# EAGLE schematic Resistor_Resistor (EAGLE 8.3.0), part 1 of 43 (continued)
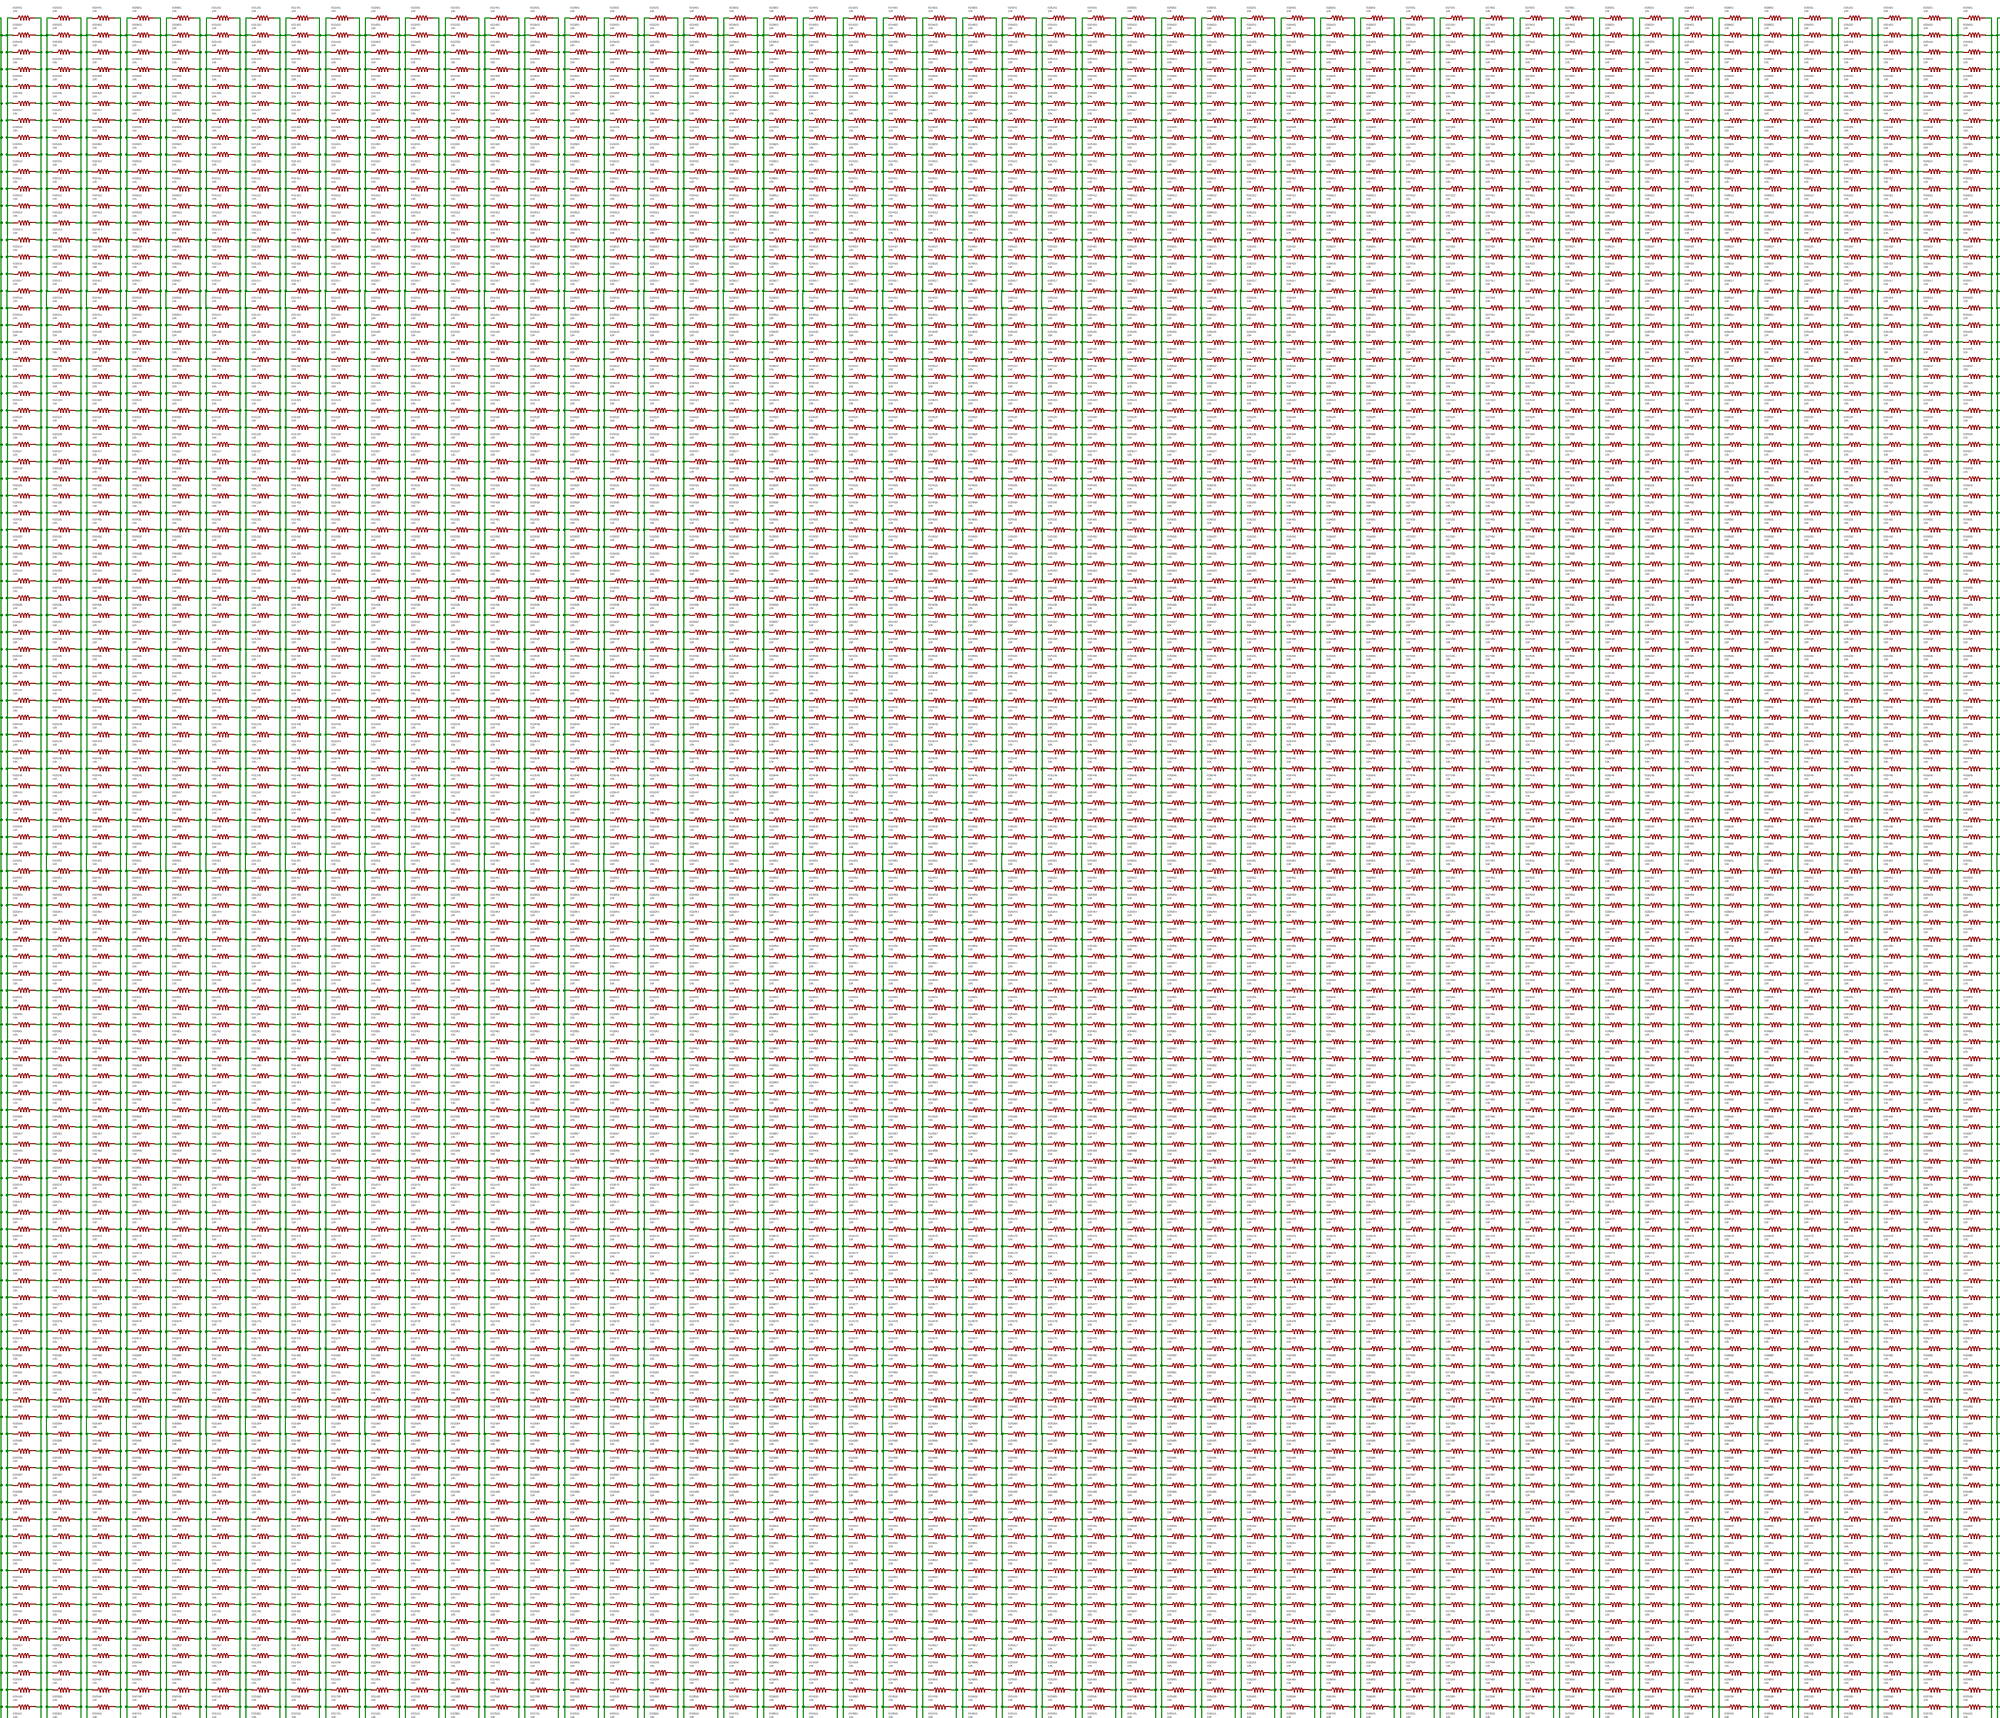
[diagram p5: schematic, sheet 1, part 5 of 8]
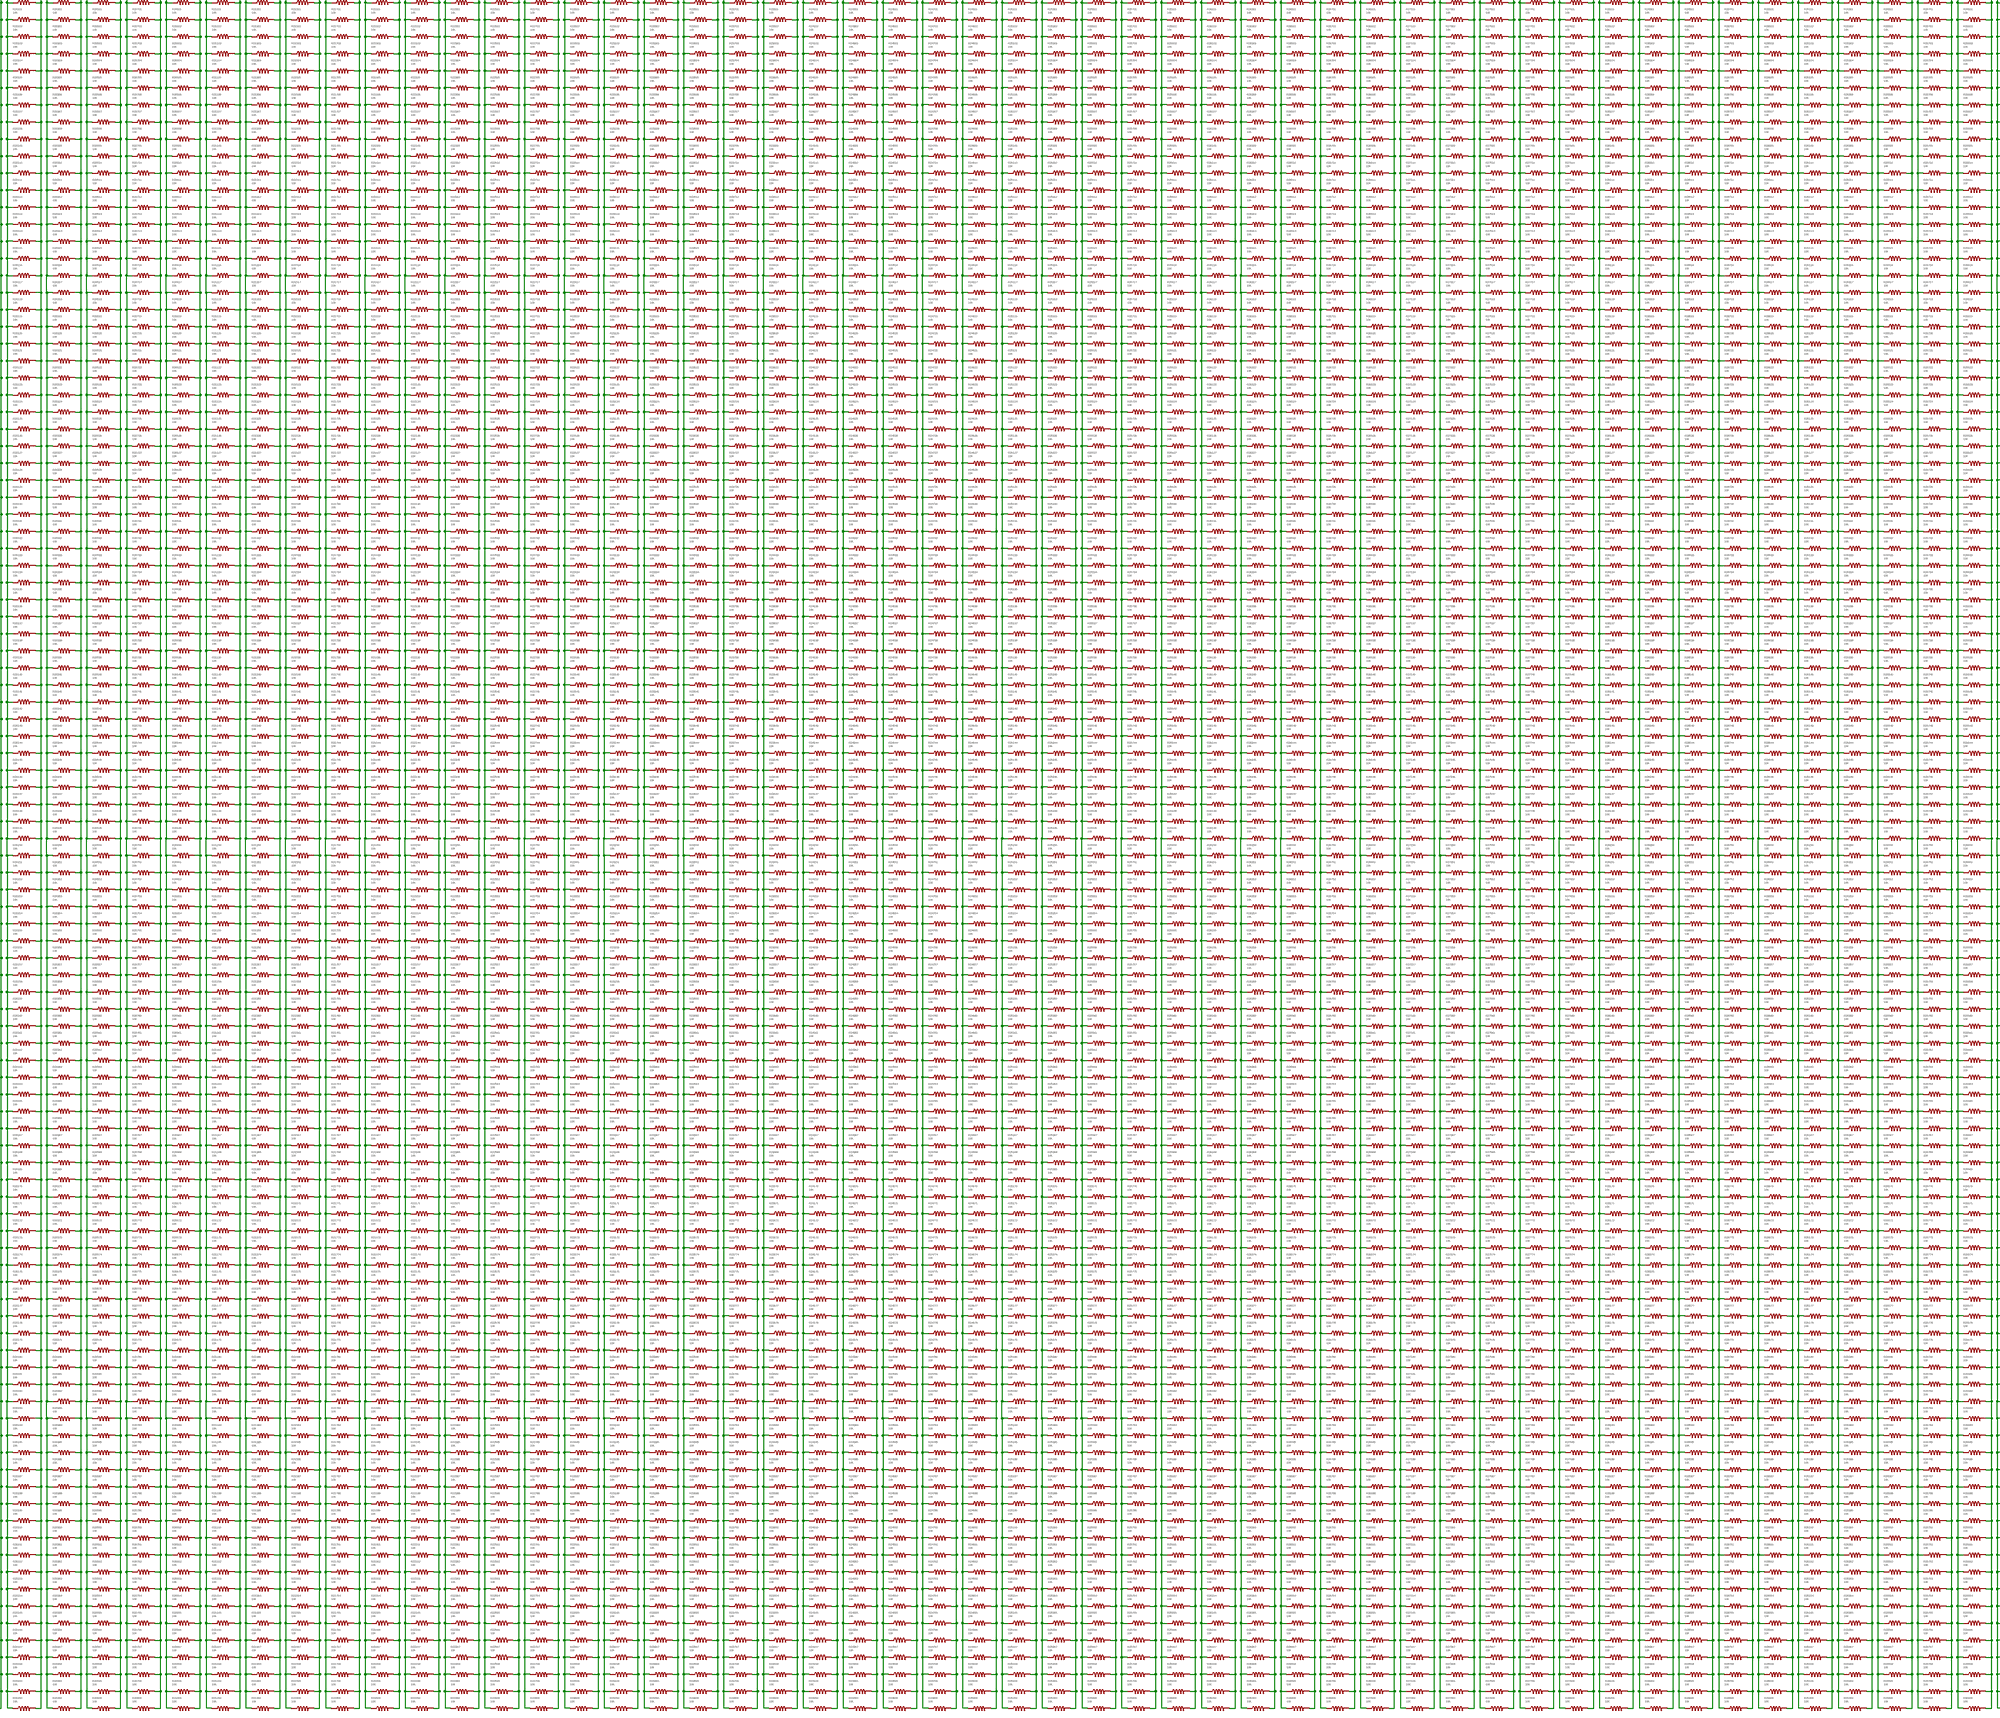
[diagram p6: schematic, sheet 1, part 6 of 8]
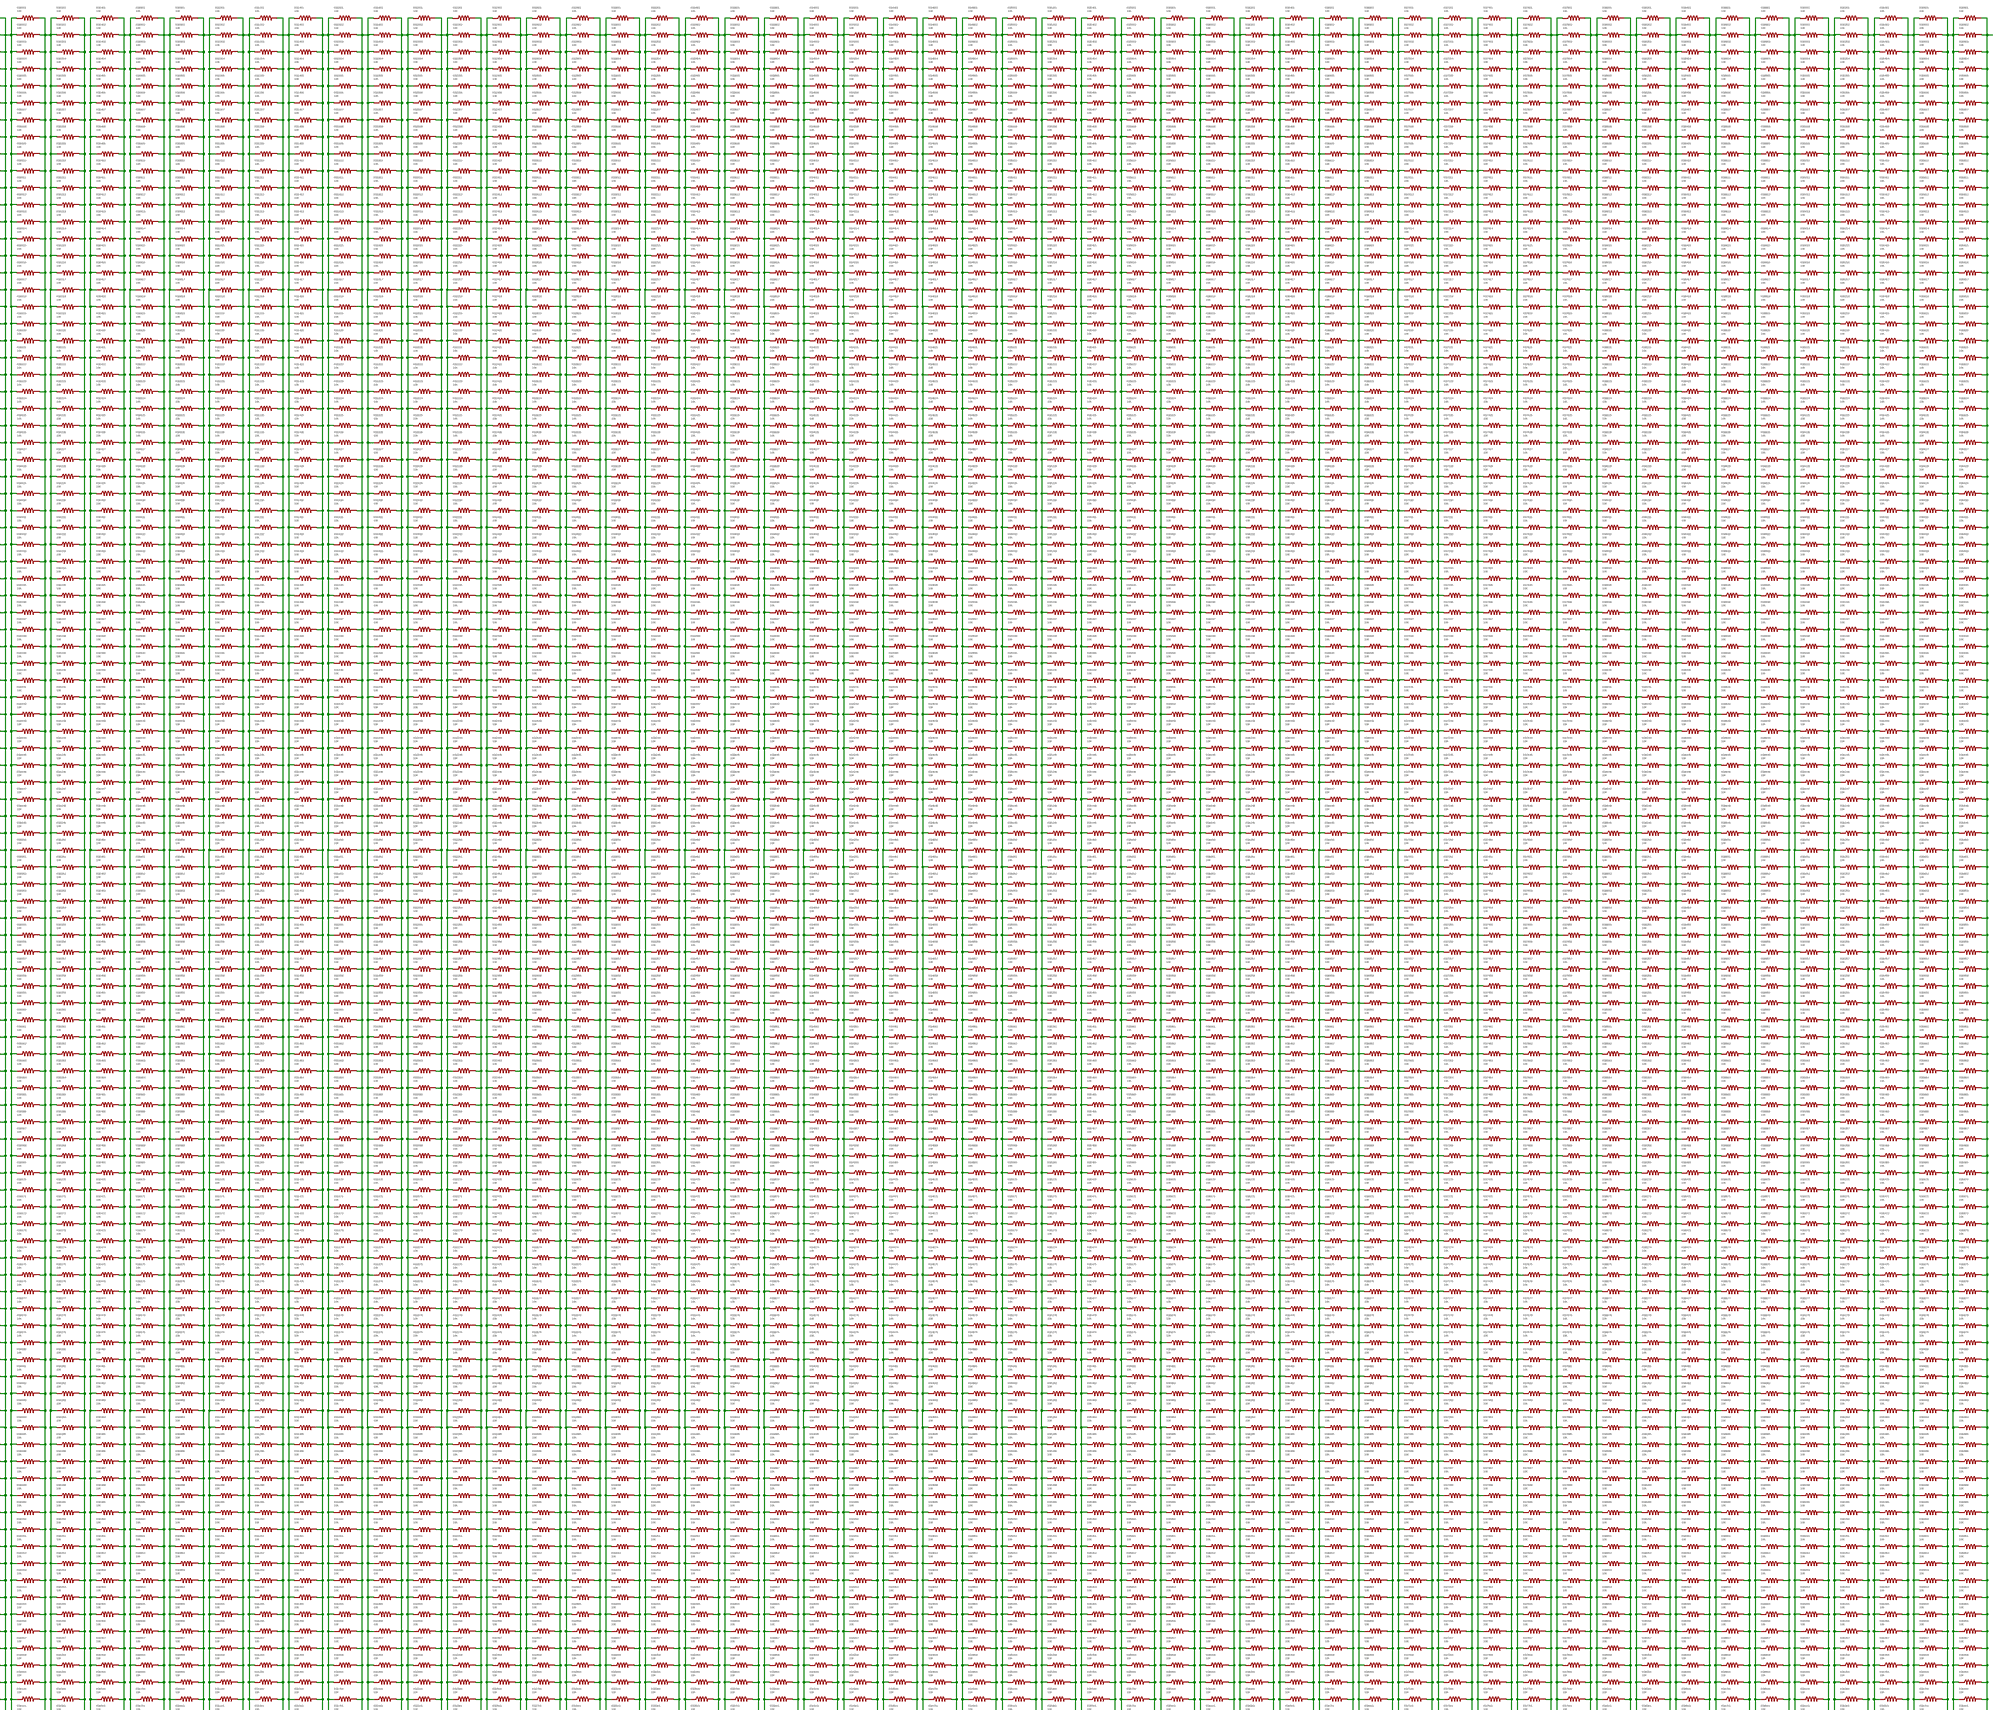
[diagram p7: schematic, sheet 1, part 7 of 8]
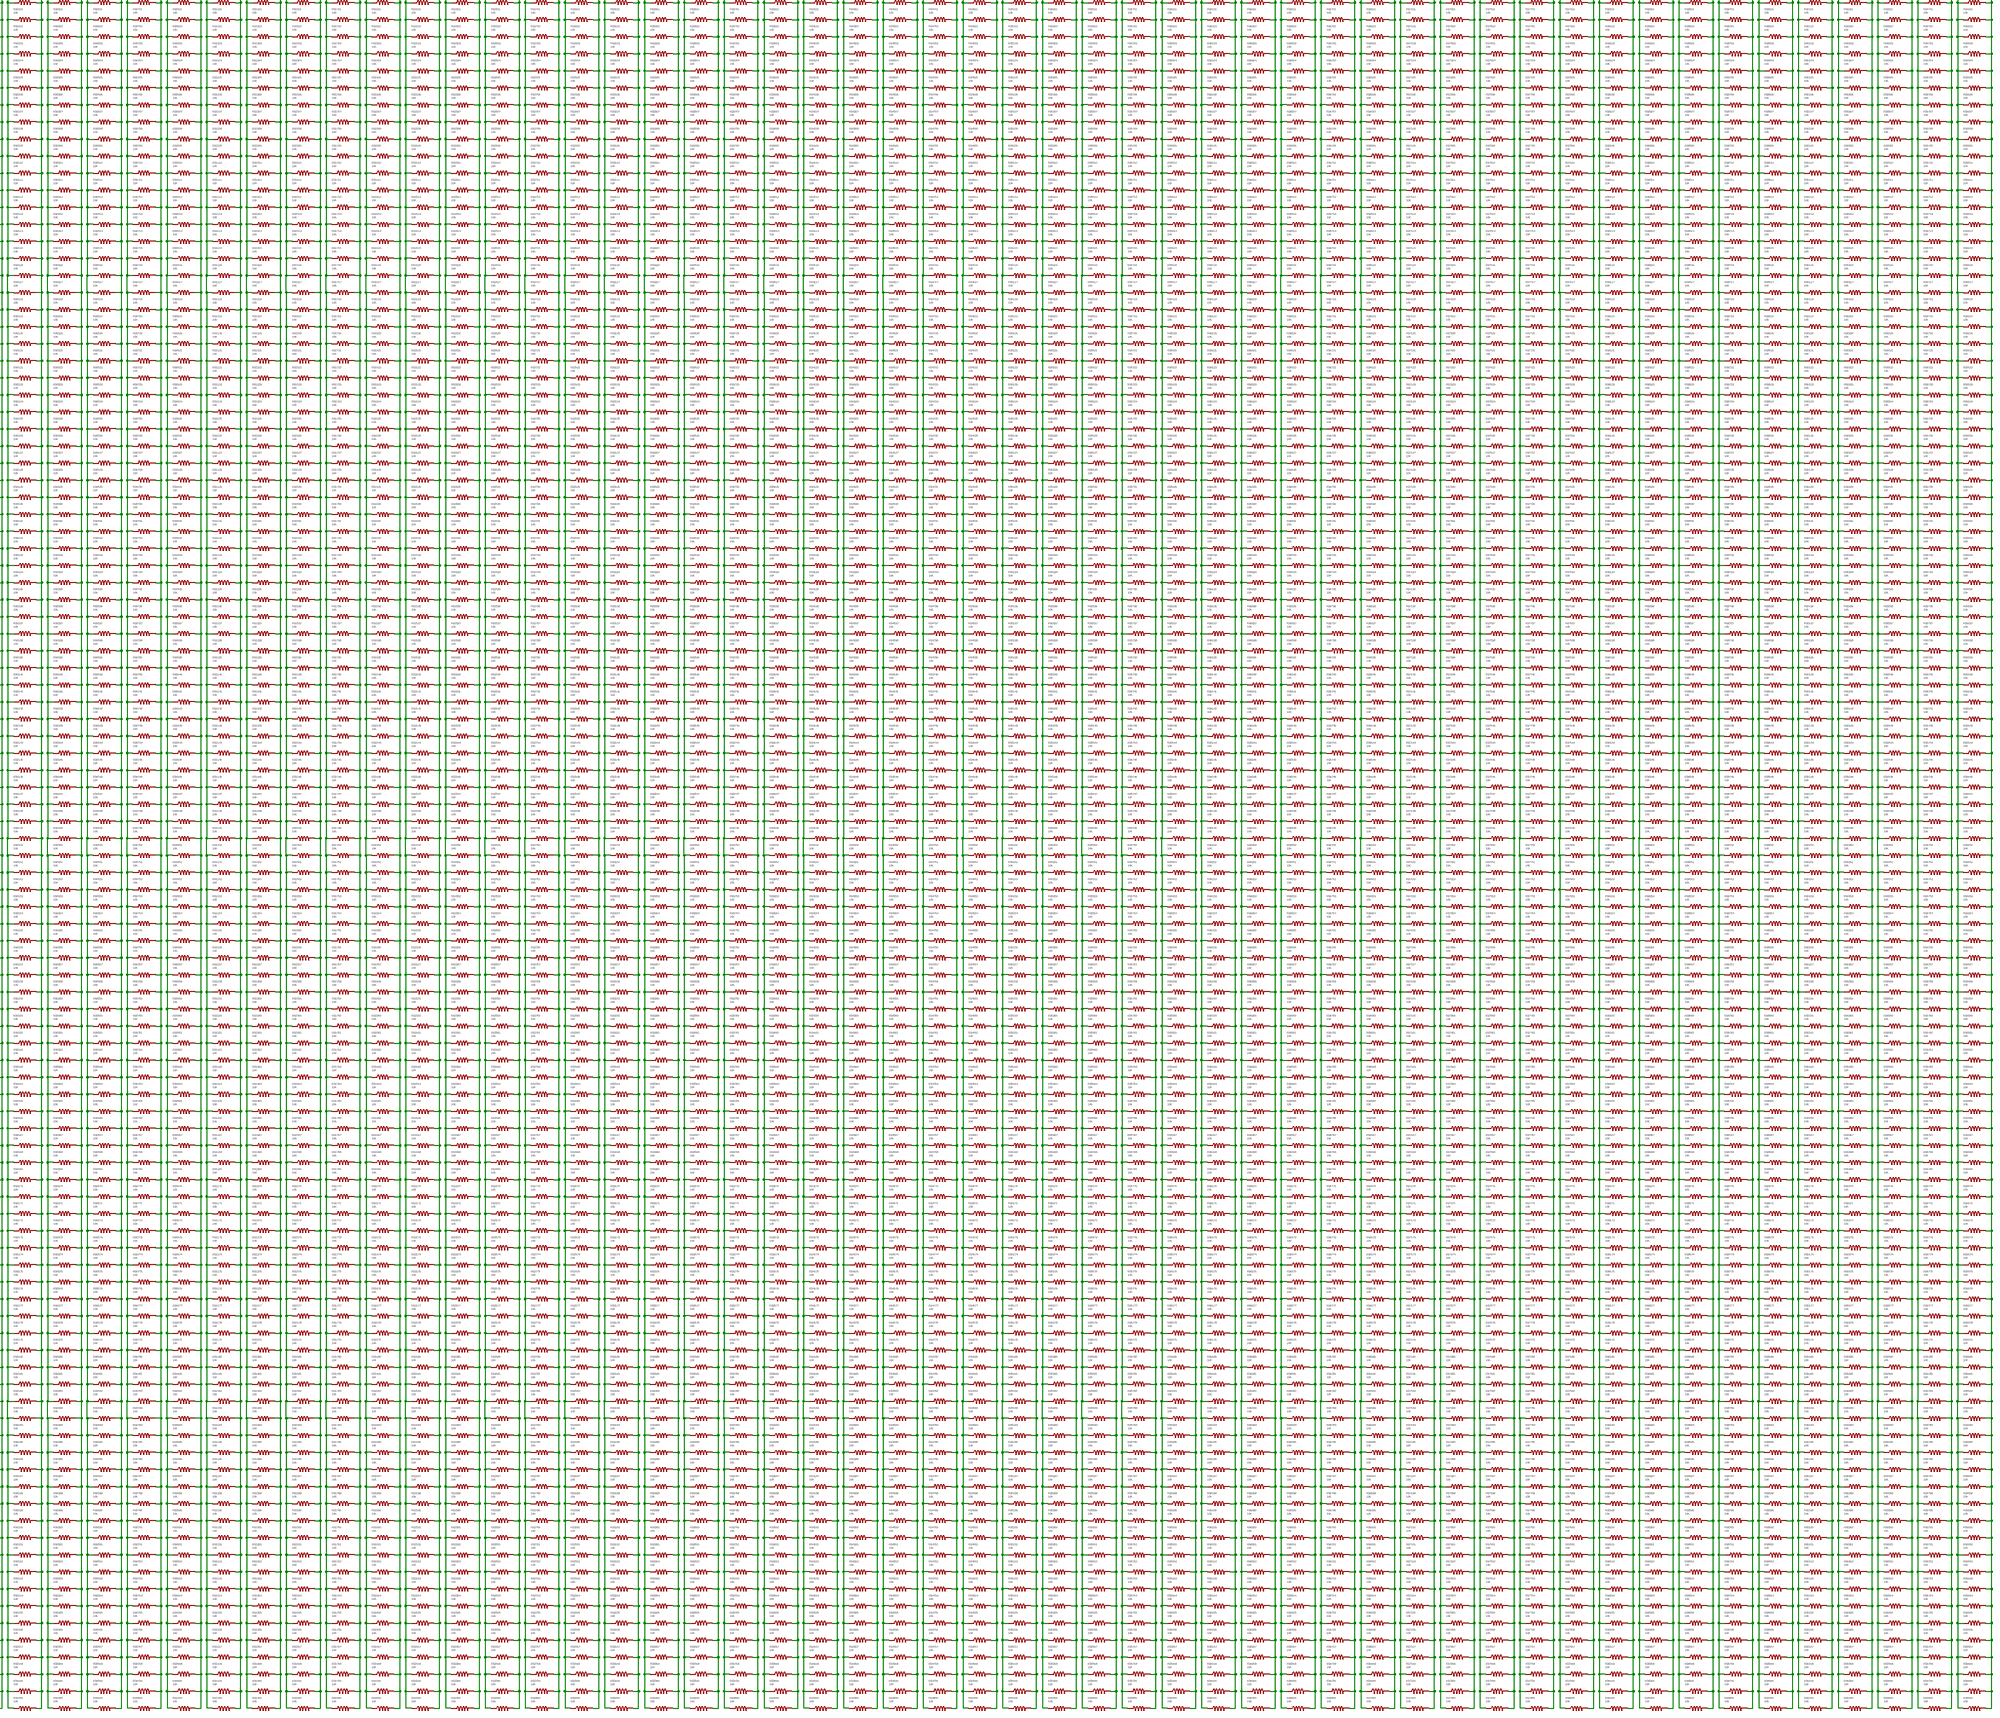
[diagram p8: schematic, sheet 1, part 8 of 8]

## Parts
FID1  FIDUCIAL_0.5MM  [FIDUCIAL_0.5MM]
FID2  FIDUCIAL_0.5MM  [FIDUCIAL_0.5MM]
FID3  FIDUCIAL_0.5MM  [FIDUCIAL_0.5MM]
R1  10K  RESISTOR_0201  [0201]
R2  10K  RESISTOR_0201  [0201]
R3  10K  RESISTOR_0201  [0201]
R4  10K  RESISTOR_0201  [0201]
R5  10K  RESISTOR_0201  [0201]
R6  10K  RESISTOR_0201  [0201]
R7  10K  RESISTOR_0201  [0201]
R8  10K  RESISTOR_0201  [0201]
R9  10K  RESISTOR_0201  [0201]
R10  10K  RESISTOR_0201  [0201]
R11  10K  RESISTOR_0201  [0201]
R12  10K  RESISTOR_0201  [0201]
R13  10K  RESISTOR_0201  [0201]
R14  10K  RESISTOR_0201  [0201]
R15  10K  RESISTOR_0201  [0201]
R16  10K  RESISTOR_0201  [0201]
R17  10K  RESISTOR_0201  [0201]
R18  10K  RESISTOR_0201  [0201]
R19  10K  RESISTOR_0201  [0201]
R20  10K  RESISTOR_0201  [0201]
R21  10K  RESISTOR_0201  [0201]
R22  10K  RESISTOR_0201  [0201]
R23  10K  RESISTOR_0201  [0201]
R24  10K  RESISTOR_0201  [0201]
R25  10K  RESISTOR_0201  [0201]
R26  10K  RESISTOR_0201  [0201]
R27  10K  RESISTOR_0201  [0201]
R28  10K  RESISTOR_0201  [0201]
R29  10K  RESISTOR_0201  [0201]
R30  10K  RESISTOR_0201  [0201]
R31  10K  RESISTOR_0201  [0201]
R32  10K  RESISTOR_0201  [0201]
R33  10K  RESISTOR_0201  [0201]
R34  10K  RESISTOR_0201  [0201]
R35  10K  RESISTOR_0201  [0201]
R36  10K  RESISTOR_0201  [0201]
R37  10K  RESISTOR_0201  [0201]
R38  10K  RESISTOR_0201  [0201]
R39  10K  RESISTOR_0201  [0201]
R40  10K  RESISTOR_0201  [0201]
R41  10K  RESISTOR_0201  [0201]
R42  10K  RESISTOR_0201  [0201]
R43  10K  RESISTOR_0201  [0201]
R44  10K  RESISTOR_0201  [0201]
R45  10K  RESISTOR_0201  [0201]
R46  10K  RESISTOR_0201  [0201]
R47  10K  RESISTOR_0201  [0201]
R48  10K  RESISTOR_0201  [0201]
R49  10K  RESISTOR_0201  [0201]
R50  10K  RESISTOR_0201  [0201]
R51  10K  RESISTOR_0201  [0201]
R52  10K  RESISTOR_0201  [0201]
R53  10K  RESISTOR_0201  [0201]
R54  10K  RESISTOR_0201  [0201]
R55  10K  RESISTOR_0201  [0201]
R56  10K  RESISTOR_0201  [0201]
R57  10K  RESISTOR_0201  [0201]
R58  10K  RESISTOR_0201  [0201]
R59  10K  RESISTOR_0201  [0201]
R60  10K  RESISTOR_0201  [0201]
R61  10K  RESISTOR_0201  [0201]
R62  10K  RESISTOR_0201  [0201]
R63  10K  RESISTOR_0201  [0201]
R64  10K  RESISTOR_0201  [0201]
R65  10K  RESISTOR_0201  [0201]
R66  10K  RESISTOR_0201  [0201]
R67  10K  RESISTOR_0201  [0201]
R68  10K  RESISTOR_0201  [0201]
R69  10K  RESISTOR_0201  [0201]
R70  10K  RESISTOR_0201  [0201]
R71  10K  RESISTOR_0201  [0201]
R72  10K  RESISTOR_0201  [0201]
R73  10K  RESISTOR_0201  [0201]
R74  10K  RESISTOR_0201  [0201]
R75  10K  RESISTOR_0201  [0201]
R76  10K  RESISTOR_0201  [0201]
R77  10K  RESISTOR_0201  [0201]
R78  10K  RESISTOR_0201  [0201]
R79  10K  RESISTOR_0201  [0201]
R80  10K  RESISTOR_0201  [0201]
R81  10K  RESISTOR_0201  [0201]
R82  10K  RESISTOR_0201  [0201]
R83  10K  RESISTOR_0201  [0201]
R84  10K  RESISTOR_0201  [0201]
R85  10K  RESISTOR_0201  [0201]
R86  10K  RESISTOR_0201  [0201]
R87  10K  RESISTOR_0201  [0201]
R88  10K  RESISTOR_0201  [0201]
R89  10K  RESISTOR_0201  [0201]
R90  10K  RESISTOR_0201  [0201]
R91  10K  RESISTOR_0201  [0201]
R92  10K  RESISTOR_0201  [0201]
R93  10K  RESISTOR_0201  [0201]
R94  10K  RESISTOR_0201  [0201]
R95  10K  RESISTOR_0201  [0201]
R96  10K  RESISTOR_0201  [0201]
R97  10K  RESISTOR_0201  [0201]
R98  10K  RESISTOR_0201  [0201]
R99  10K  RESISTOR_0201  [0201]
R100  10K  RESISTOR_0201  [0201]
R101  10K  RESISTOR_0201  [0201]
R102  10K  RESISTOR_0201  [0201]
R103  10K  RESISTOR_0201  [0201]
R104  10K  RESISTOR_0201  [0201]
R105  10K  RESISTOR_0201  [0201]
R106  10K  RESISTOR_0201  [0201]
R107  10K  RESISTOR_0201  [0201]
R108  10K  RESISTOR_0201  [0201]
R109  10K  RESISTOR_0201  [0201]
R110  10K  RESISTOR_0201  [0201]
R111  10K  RESISTOR_0201  [0201]
R112  10K  RESISTOR_0201  [0201]
R113  10K  RESISTOR_0201  [0201]
R114  10K  RESISTOR_0201  [0201]
R115  10K  RESISTOR_0201  [0201]
R116  10K  RESISTOR_0201  [0201]
R117  10K  RESISTOR_0201  [0201]
R118  10K  RESISTOR_0201  [0201]
R119  10K  RESISTOR_0201  [0201]
R120  10K  RESISTOR_0201  [0201]
R121  10K  RESISTOR_0201  [0201]
R122  10K  RESISTOR_0201  [0201]
R123  10K  RESISTOR_0201  [0201]
R124  10K  RESISTOR_0201  [0201]
R125  10K  RESISTOR_0201  [0201]
R126  10K  RESISTOR_0201  [0201]
R127  10K  RESISTOR_0201  [0201]
R128  10K  RESISTOR_0201  [0201]
R129  10K  RESISTOR_0201  [0201]
R130  10K  RESISTOR_0201  [0201]
R131  10K  RESISTOR_0201  [0201]
R132  10K  RESISTOR_0201  [0201]
R133  10K  RESISTOR_0201  [0201]
R134  10K  RESISTOR_0201  [0201]
R135  10K  RESISTOR_0201  [0201]
R136  10K  RESISTOR_0201  [0201]
R137  10K  RESISTOR_0201  [0201]
R138  10K  RESISTOR_0201  [0201]
R139  10K  RESISTOR_0201  [0201]
R140  10K  RESISTOR_0201  [0201]
R141  10K  RESISTOR_0201  [0201]
R142  10K  RESISTOR_0201  [0201]
R143  10K  RESISTOR_0201  [0201]
R144  10K  RESISTOR_0201  [0201]
R145  10K  RESISTOR_0201  [0201]
R146  10K  RESISTOR_0201  [0201]
R147  10K  RESISTOR_0201  [0201]
R148  10K  RESISTOR_0201  [0201]
R149  10K  RESISTOR_0201  [0201]
R150  10K  RESISTOR_0201  [0201]
R151  10K  RESISTOR_0201  [0201]
R152  10K  RESISTOR_0201  [0201]
R153  10K  RESISTOR_0201  [0201]
R154  10K  RESISTOR_0201  [0201]
R155  10K  RESISTOR_0201  [0201]
R156  10K  RESISTOR_0201  [0201]
R157  10K  RESISTOR_0201  [0201]
R158  10K  RESISTOR_0201  [0201]
R159  10K  RESISTOR_0201  [0201]
R160  10K  RESISTOR_0201  [0201]
R161  10K  RESISTOR_0201  [0201]
R162  10K  RESISTOR_0201  [0201]
R163  10K  RESISTOR_0201  [0201]
R164  10K  RESISTOR_0201  [0201]
R165  10K  RESISTOR_0201  [0201]
R166  10K  RESISTOR_0201  [0201]
R167  10K  RESISTOR_0201  [0201]
R168  10K  RESISTOR_0201  [0201]
R169  10K  RESISTOR_0201  [0201]
R170  10K  RESISTOR_0201  [0201]
R171  10K  RESISTOR_0201  [0201]
R172  10K  RESISTOR_0201  [0201]
R173  10K  RESISTOR_0201  [0201]
R174  10K  RESISTOR_0201  [0201]
R175  10K  RESISTOR_0201  [0201]
R176  10K  RESISTOR_0201  [0201]
R177  10K  RESISTOR_0201  [0201]
R178  10K  RESISTOR_0201  [0201]
R179  10K  RESISTOR_0201  [0201]
R180  10K  RESISTOR_0201  [0201]
R181  10K  RESISTOR_0201  [0201]
R182  10K  RESISTOR_0201  [0201]
R183  10K  RESISTOR_0201  [0201]
R184  10K  RESISTOR_0201  [0201]
R185  10K  RESISTOR_0201  [0201]
R186  10K  RESISTOR_0201  [0201]
R187  10K  RESISTOR_0201  [0201]
R188  10K  RESISTOR_0201  [0201]
R189  10K  RESISTOR_0201  [0201]
R190  10K  RESISTOR_0201  [0201]
R191  10K  RESISTOR_0201  [0201]
R192  10K  RESISTOR_0201  [0201]
R193  10K  RESISTOR_0201  [0201]
R194  10K  RESISTOR_0201  [0201]
R195  10K  RESISTOR_0201  [0201]
R196  10K  RESISTOR_0201  [0201]
R197  10K  RESISTOR_0201  [0201]
R198  10K  RESISTOR_0201  [0201]
R199  10K  RESISTOR_0201  [0201]
R200  10K  RESISTOR_0201  [0201]
R201  10K  RESISTOR_0201  [0201]
R202  10K  RESISTOR_0201  [0201]
R203  10K  RESISTOR_0201  [0201]
R204  10K  RESISTOR_0201  [0201]
R205  10K  RESISTOR_0201  [0201]
R206  10K  RESISTOR_0201  [0201]
R207  10K  RESISTOR_0201  [0201]
R208  10K  RESISTOR_0201  [0201]
R209  10K  RESISTOR_0201  [0201]
R210  10K  RESISTOR_0201  [0201]
R211  10K  RESISTOR_0201  [0201]
R212  10K  RESISTOR_0201  [0201]
R213  10K  RESISTOR_0201  [0201]
R214  10K  RESISTOR_0201  [0201]
R215  10K  RESISTOR_0201  [0201]
R216  10K  RESISTOR_0201  [0201]
R217  10K  RESISTOR_0201  [0201]
R218  10K  RESISTOR_0201  [0201]
R219  10K  RESISTOR_0201  [0201]
R220  10K  RESISTOR_0201  [0201]
R221  10K  RESISTOR_0201  [0201]
R222  10K  RESISTOR_0201  [0201]
R223  10K  RESISTOR_0201  [0201]
R224  10K  RESISTOR_0201  [0201]
R225  10K  RESISTOR_0201  [0201]
R226  10K  RESISTOR_0201  [0201]
R227  10K  RESISTOR_0201  [0201]
R228  10K  RESISTOR_0201  [0201]
R229  10K  RESISTOR_0201  [0201]
R230  10K  RESISTOR_0201  [0201]
R231  10K  RESISTOR_0201  [0201]
R232  10K  RESISTOR_0201  [0201]
R233  10K  RESISTOR_0201  [0201]
R234  10K  RESISTOR_0201  [0201]
R235  10K  RESISTOR_0201  [0201]
R236  10K  RESISTOR_0201  [0201]
R237  10K  RESISTOR_0201  [0201]
R238  10K  RESISTOR_0201  [0201]
R239  10K  RESISTOR_0201  [0201]
R240  10K  RESISTOR_0201  [0201]
R241  10K  RESISTOR_0201  [0201]
R242  10K  RESISTOR_0201  [0201]
R243  10K  RESISTOR_0201  [0201]
R244  10K  RESISTOR_0201  [0201]
R245  10K  RESISTOR_0201  [0201]
R246  10K  RESISTOR_0201  [0201]
R247  10K  RESISTOR_0201  [0201]
R248  10K  RESISTOR_0201  [0201]
R249  10K  RESISTOR_0201  [0201]
R250  10K  RESISTOR_0201  [0201]
R251  10K  RESISTOR_0201  [0201]
R252  10K  RESISTOR_0201  [0201]
R253  10K  RESISTOR_0201  [0201]
R254  10K  RESISTOR_0201  [0201]
R255  10K  RESISTOR_0201  [0201]
R256  10K  RESISTOR_0201  [0201]
R257  10K  RESISTOR_0201  [0201]
R258  10K  RESISTOR_0201  [0201]
R259  10K  RESISTOR_0201  [0201]
R260  10K  RESISTOR_0201  [0201]
R261  10K  RESISTOR_0201  [0201]
R262  10K  RESISTOR_0201  [0201]
R263  10K  RESISTOR_0201  [0201]
R264  10K  RESISTOR_0201  [0201]
R265  10K  RESISTOR_0201  [0201]
R266  10K  RESISTOR_0201  [0201]
R267  10K  RESISTOR_0201  [0201]
R268  10K  RESISTOR_0201  [0201]
R269  10K  RESISTOR_0201  [0201]
R270  10K  RESISTOR_0201  [0201]
R271  10K  RESISTOR_0201  [0201]
R272  10K  RESISTOR_0201  [0201]
R273  10K  RESISTOR_0201  [0201]
R274  10K  RESISTOR_0201  [0201]
R275  10K  RESISTOR_0201  [0201]
R276  10K  RESISTOR_0201  [0201]
R277  10K  RESISTOR_0201  [0201]
R278  10K  RESISTOR_0201  [0201]
R279  10K  RESISTOR_0201  [0201]
R280  10K  RESISTOR_0201  [0201]
R281  10K  RESISTOR_0201  [0201]
R282  10K  RESISTOR_0201  [0201]
R283  10K  RESISTOR_0201  [0201]
R284  10K  RESISTOR_0201  [0201]
R285  10K  RESISTOR_0201  [0201]
R286  10K  RESISTOR_0201  [0201]
R287  10K  RESISTOR_0201  [0201]
R288  10K  RESISTOR_0201  [0201]
R289  10K  RESISTOR_0201  [0201]
R290  10K  RESISTOR_0201  [0201]
R291  10K  RESISTOR_0201  [0201]
R292  10K  RESISTOR_0201  [0201]
R293  10K  RESISTOR_0201  [0201]
R294  10K  RESISTOR_0201  [0201]
R295  10K  RESISTOR_0201  [0201]
R296  10K  RESISTOR_0201  [0201]
R297  10K  RESISTOR_0201  [0201]
R298  10K  RESISTOR_0201  [0201]
R299  10K  RESISTOR_0201  [0201]
R300  10K  RESISTOR_0201  [0201]
R301  10K  RESISTOR_0201  [0201]
R302  10K  RESISTOR_0201  [0201]
R303  10K  RESISTOR_0201  [0201]
R304  10K  RESISTOR_0201  [0201]
R305  10K  RESISTOR_0201  [0201]
R306  10K  RESISTOR_0201  [0201]
R307  10K  RESISTOR_0201  [0201]
R308  10K  RESISTOR_0201  [0201]
R309  10K  RESISTOR_0201  [0201]
R310  10K  RESISTOR_0201  [0201]
R311  10K  RESISTOR_0201  [0201]
R312  10K  RESISTOR_0201  [0201]
R313  10K  RESISTOR_0201  [0201]
R314  10K  RESISTOR_0201  [0201]
R315  10K  RESISTOR_0201  [0201]
R316  10K  RESISTOR_0201  [0201]
R317  10K  RESISTOR_0201  [0201]
R318  10K  RESISTOR_0201  [0201]
R319  10K  RESISTOR_0201  [0201]
R320  10K  RESISTOR_0201  [0201]
R321  10K  RESISTOR_0201  [0201]
R322  10K  RESISTOR_0201  [0201]